# EasyEDA Pro project 温湿度及气体检测装置.eprj

# Schematic Schematic1
Create Date: 2024-08-19; Page Name: P1; Project Name: 温湿度及气体检测装置; Schematic Name: Schematic1; Update Date: 2024-08-25; Company: tllwtg; Page Size: A4; Version: V1.0
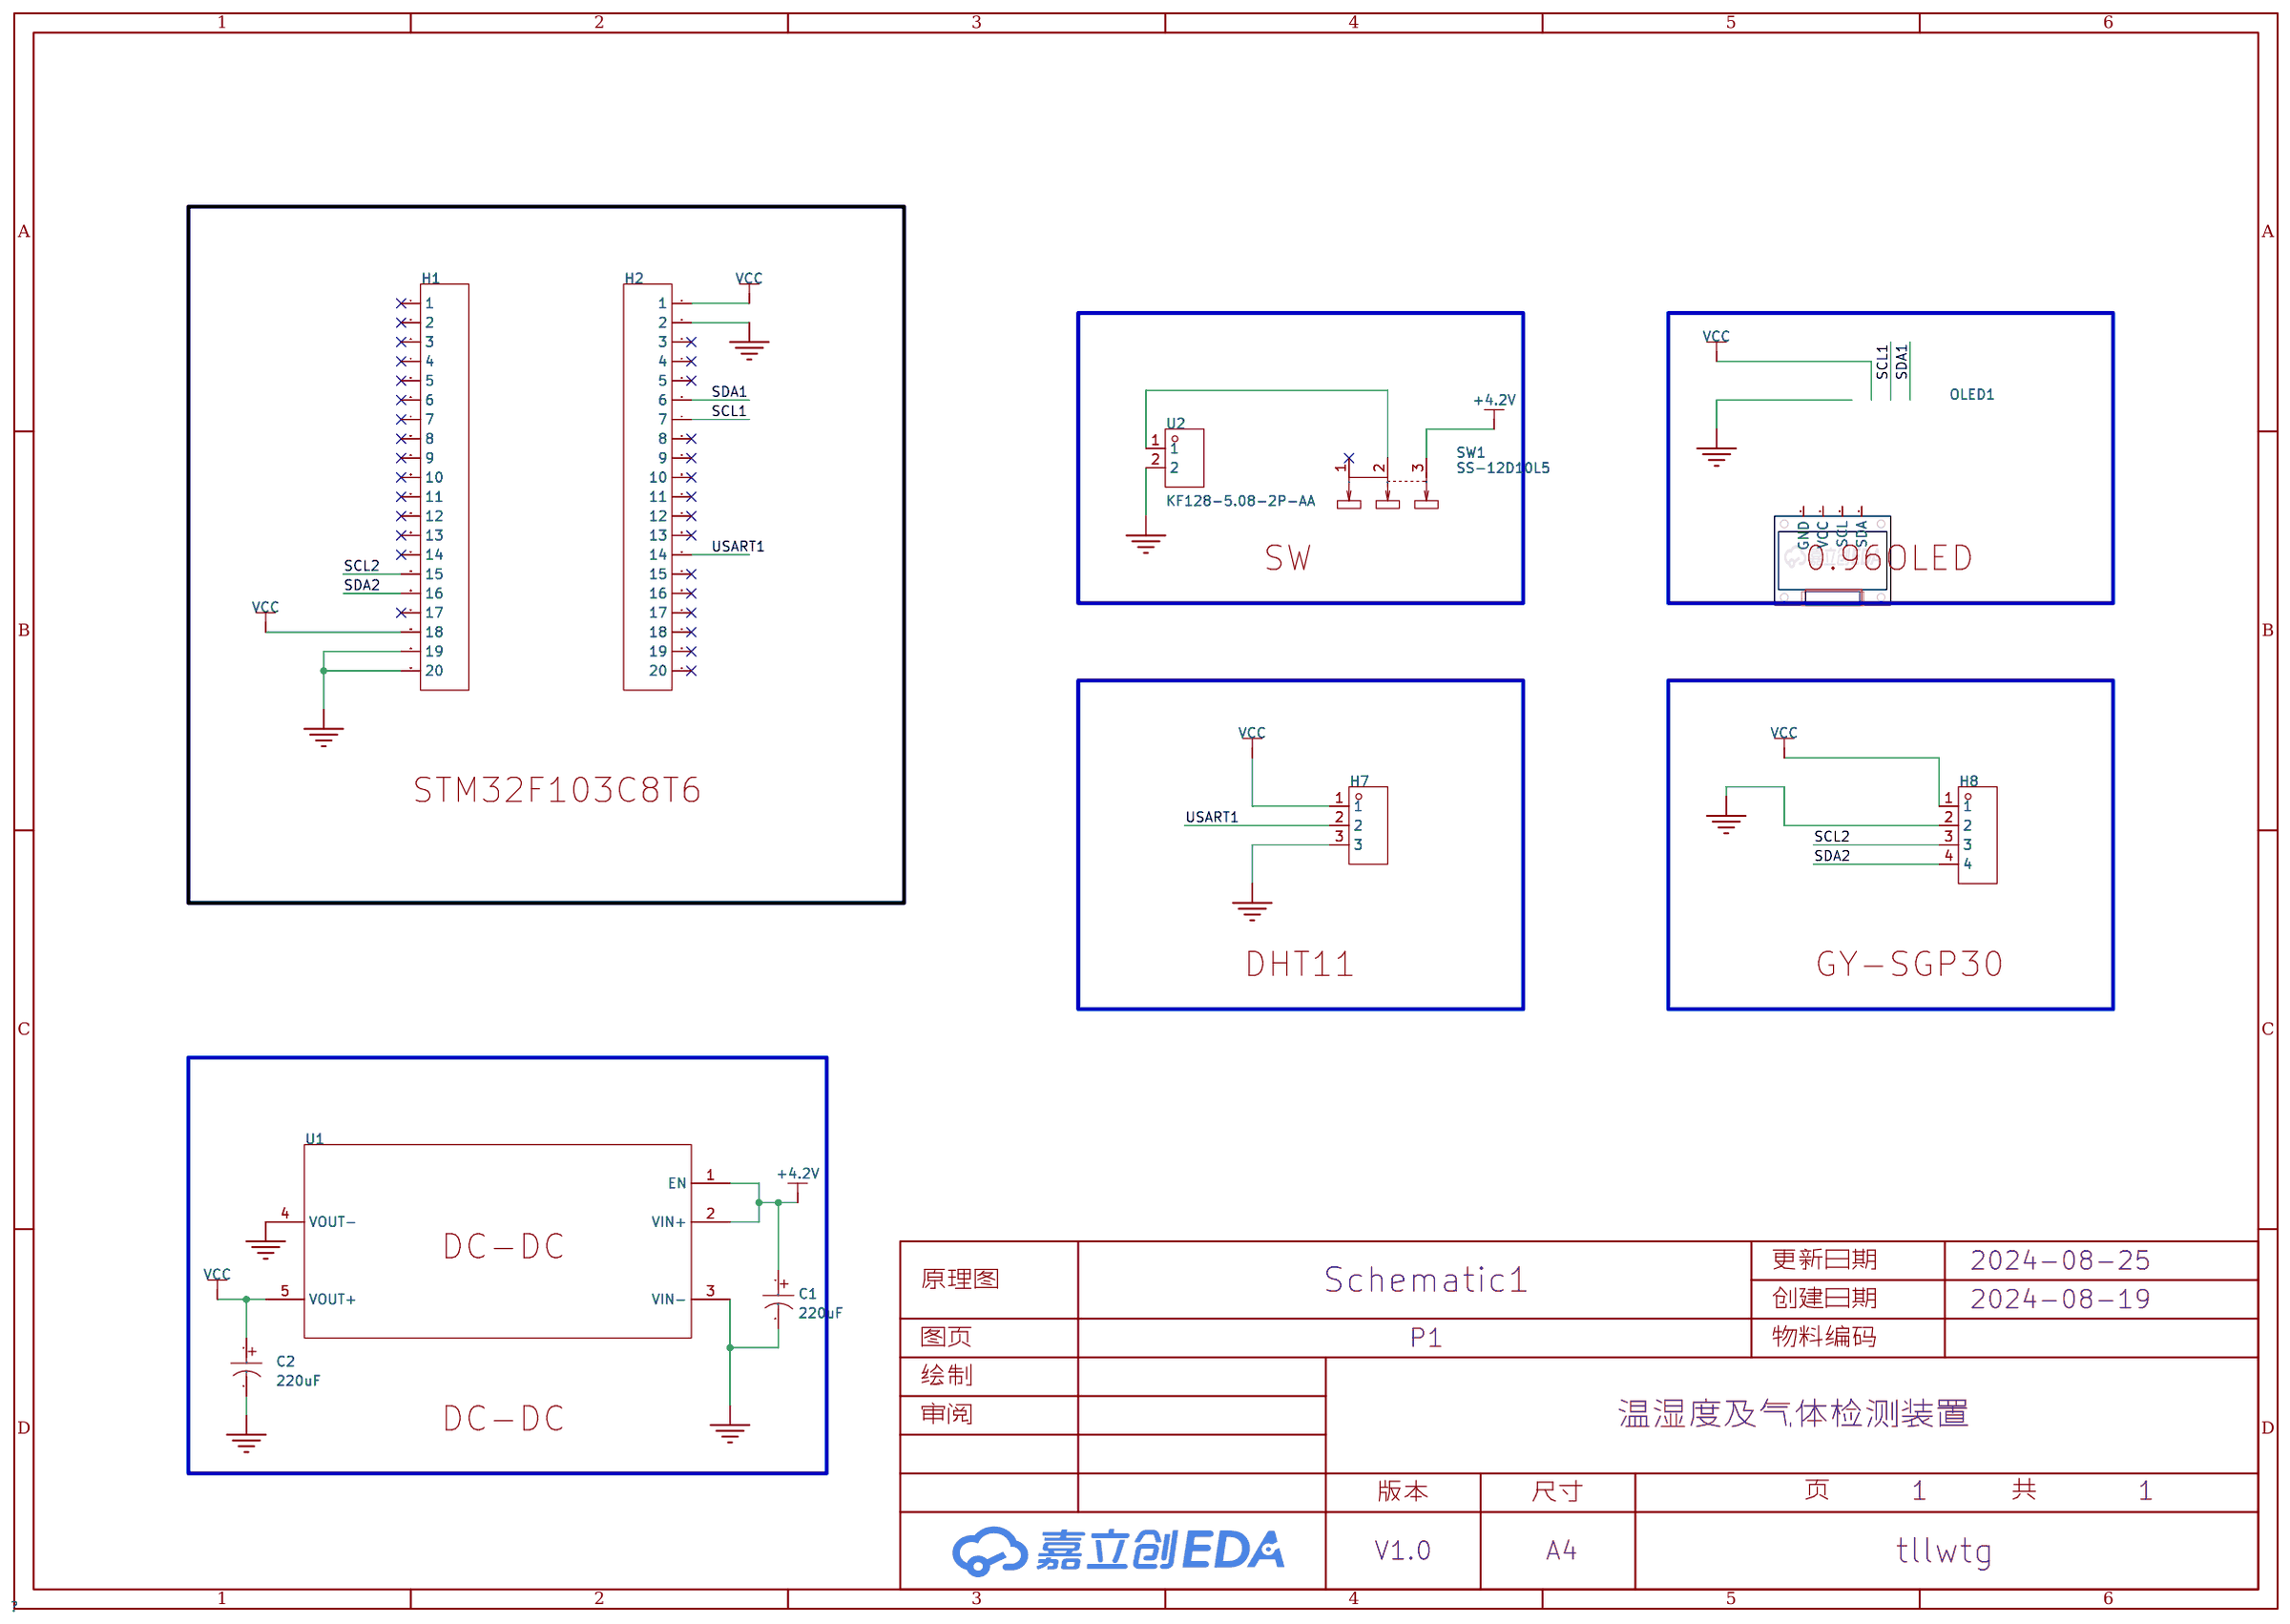
[diagram p0: schematic sheet]

## Parts
C1  220uF  [CAP-TH_BD6.3-P2.50-D1.0-FD]
C2  220uF  [CAP-TH_BD6.3-P2.50-D1.0-FD]
H1  -  [HDR-TH_20P-P2.54-V-F]
H2  -  [HDR-TH_20P-P2.54-V-F]
H7  -  [HDR-TH_3P-P2.54-V-F]
H8  -  [HDR-TH_4P-P2.54-V-F]
OLED1  -  [0.96OLED_4P]
SW1  SS-12D10L5  [SW-TH_SS-12D10L5]
U1  -  [DC-DC_upd]
U2  KF128-5.08-2P-AA  [CONN-TH_P5.08_KF128-5.08-2P]

## Library data of the parts
C1 C2 = ERS1CM221E11OT: 容值:220uF;精度:±20%;额定电压:16V;; LCSC Part Name: 220uF ±20% 16V; Supplier Part: C106643; Manufacturer: AISHI(艾华集团); Supplier Footprint: 插件,D6.3xL11mm; JLCPCB Part Class: 扩展库; Datasheet: https://atta.szlcsc.com/upload/public/pdf/source/20191015/C438940_4B8E60A742BB0AE40DDEF87A5C89089D.pdf; Supplier: LCSC; Tolerance: ±20%; Rated Voltage: 16V; Lead Spacing: 2.5mm; φD: 6.3mm; L: 11mm; Lifetime @ Temp: 5000hrs@105℃
H1 H2 = HDR-F_2.54_1x20P: Supplier Part: C50984; Supplier Footprint: 插件; Check: true
H7 = HDR-F_2.54_1x3P: Supplier Part: C541850; Supplier Footprint: 插件; Check: true
H8 = HDR-F_2.54_1x4P: Supplier Part: C2718488; Supplier Footprint: 插件; Check: true
OLED1 = 0.96OLED模块_4P: Supplier Footprint: 插件; Check: true
SW1 = SS-12D10L5: 电路结构:单刀双掷;安装方式:直插;开关颜色:黑色;额定电流(DC):3A;额定电压(DC):125V;额定电流(AC):3A;额定电压(AC):125V;机械寿命:1万次;; LCSC Part Name: 柄长5mm 直插双档 滑动开关; Supplier Part: C319012; Manufacturer: XKB Connectivity(中国星坤); Supplier Footprint: 插件; JLCPCB Part Class: 扩展库; Datasheet: https://atta.szlcsc.com/upload/public/pdf/source/20211009/D6412F37AABE6F9459A6EE7FA4DAEADB.pdf; Supplier: LCSC; Circuit: 单刀双掷; Actuator Style: 矩形柱状; Pin Style: PC引脚; Switch Length: 13mm; Switch Width: 6.8mm; Switch Height: 6.4mm; Mounting Style: 直插; Actuator Color: 黑色; Current Rating (DC): 3A; Voltage Rating (DC): 125V; Current Rating (AC): 3A; Voltage Rating (AC): 125V; Mechanical Life: 1万次; Operating Temperature: -40℃~+85℃
U1 = DC-DC: Check: true
U2 = KF128-5.08-2P-AA: 结构:1x2P;间距:5.08mm;颜色:绿色;安装方式:直插;额定电流:24A;额定电压:250V;排数:1;线规 - AWG:12~22;线规 - 平方毫米:2.5;每排PIN数:2;工作温度范围:-40℃~+105℃;; LCSC Part Name: 5.08mm 1x2P 排数:1 每排P数:2 直插; Supplier Part: C474952; Manufacturer: KEFA(科发); Supplier Footprint: 插件,P=5.08mm; JLCPCB Part Class: 扩展库; Datasheet: https://atta.szlcsc.com/upload/public/pdf/source/20230317/DADFED05827EAD48C1D5B8C3D4CF88F4.pdf; Supplier: LCSC; Structure: 1x2P; Pitch: 5.08mm; Color: 绿色; Mounting Style: 直插; Current Rating (Max): 24A; Voltage Rating (Max): 250V; Number of Pins: 2P; Number of Rows: 1; Wire Gauge - AWG: 12~22; Wire Gauge - mm2: 2.5; Number of PINs Per Row: 2; Operating Temperature Range: -40℃~+105℃; Check: true

## Nets
+4.2V: C1.1 SW1.3 U1.1(EN) U1.2(VIN+)
GND: C1.2 C2.2 H1.19 H1.20 H2.2 H7.3 H8.2 U1.3(VIN-) U1.4(VOUT-) U2.2
VCC: C2.1 H1.18 H2.1 H7.1 H8.1 U1.5(VOUT+)
SCL1: H2.7
SCL2: H1.15 H8.3
SDA1: H2.6
SDA2: H1.16 H8.4
USART1: H2.14 H7.2
$1N3125: SW1.2 U2.1

Not connected (* = marked no-connect by the designer): H1 1* 2* 3* 4* 5* 6* 7* 8* 9* 10* 11* 12* 13* 14* 17*; H2 3* 4* 5* 8* 9* 10* 11* 12* 13* 15* 16* 17* 18* 19* 20*; OLED1 1(GND) 2(VCC) 3(SCL) 4(SDA); SW1 1*

## Notes on the sheet
- SW
- 0.96OLED
- STM32F103C8T6
- DHT11
- GY-SGP30
- DC-DC

# Board PCB5
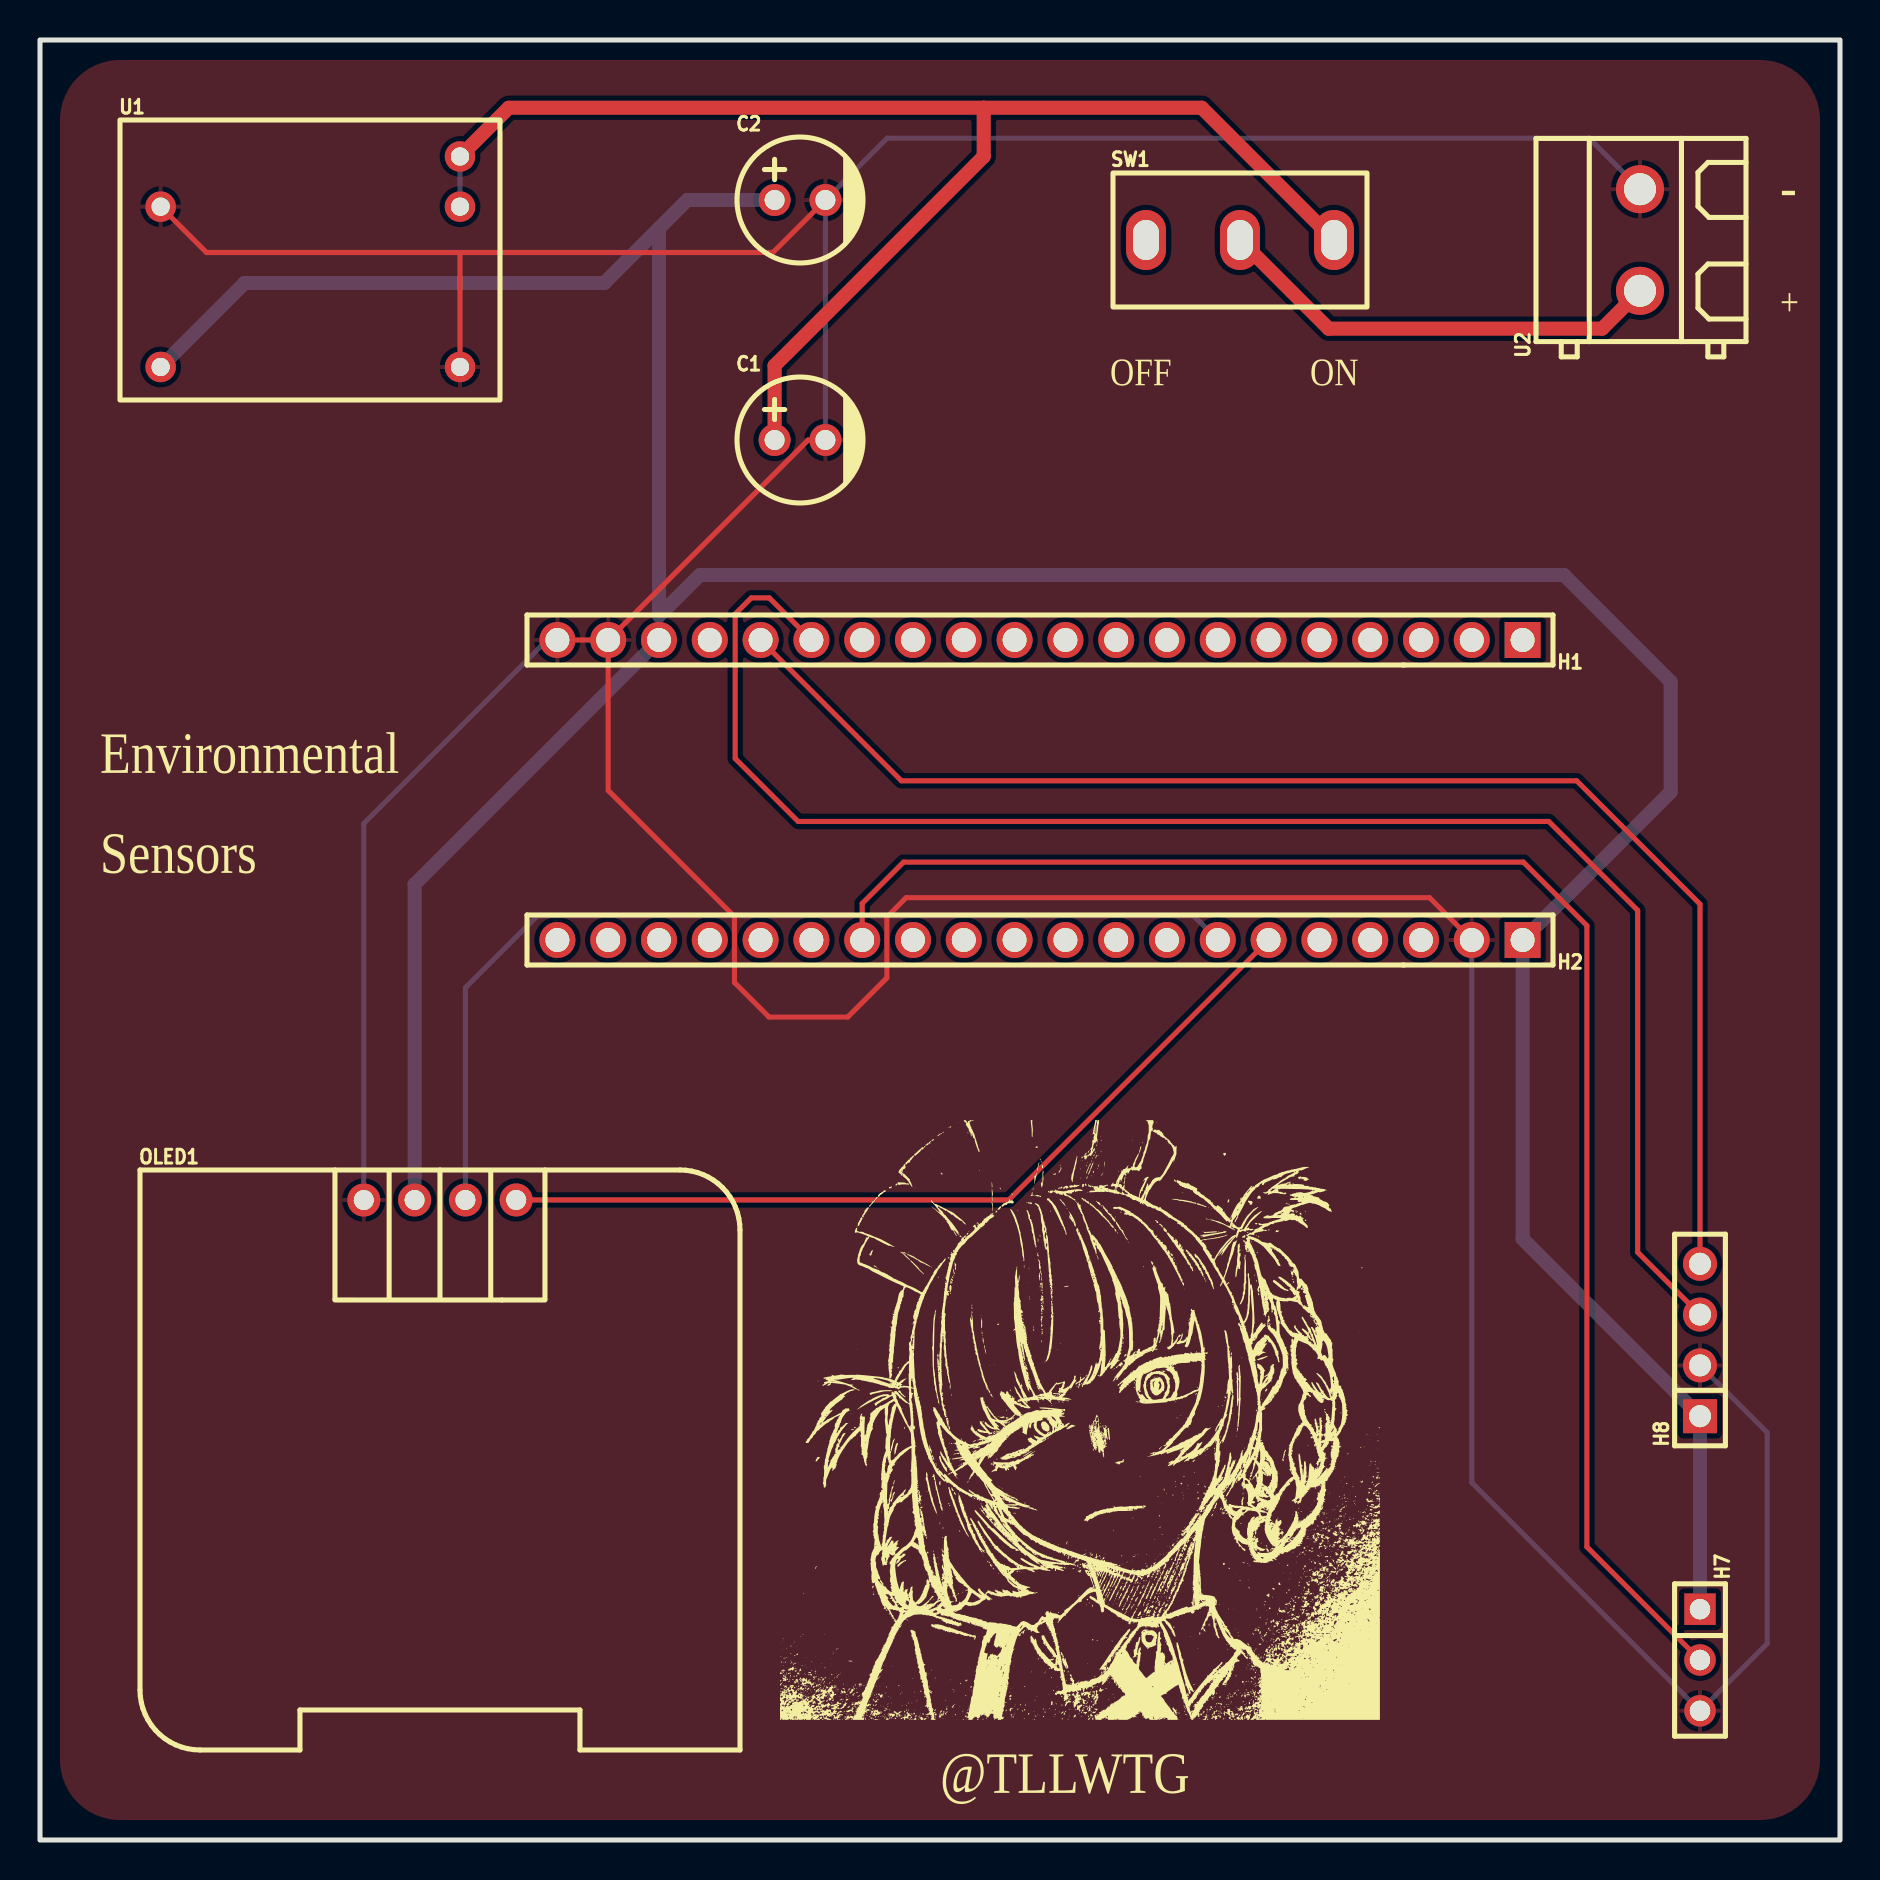
[diagram p1: board, top side]
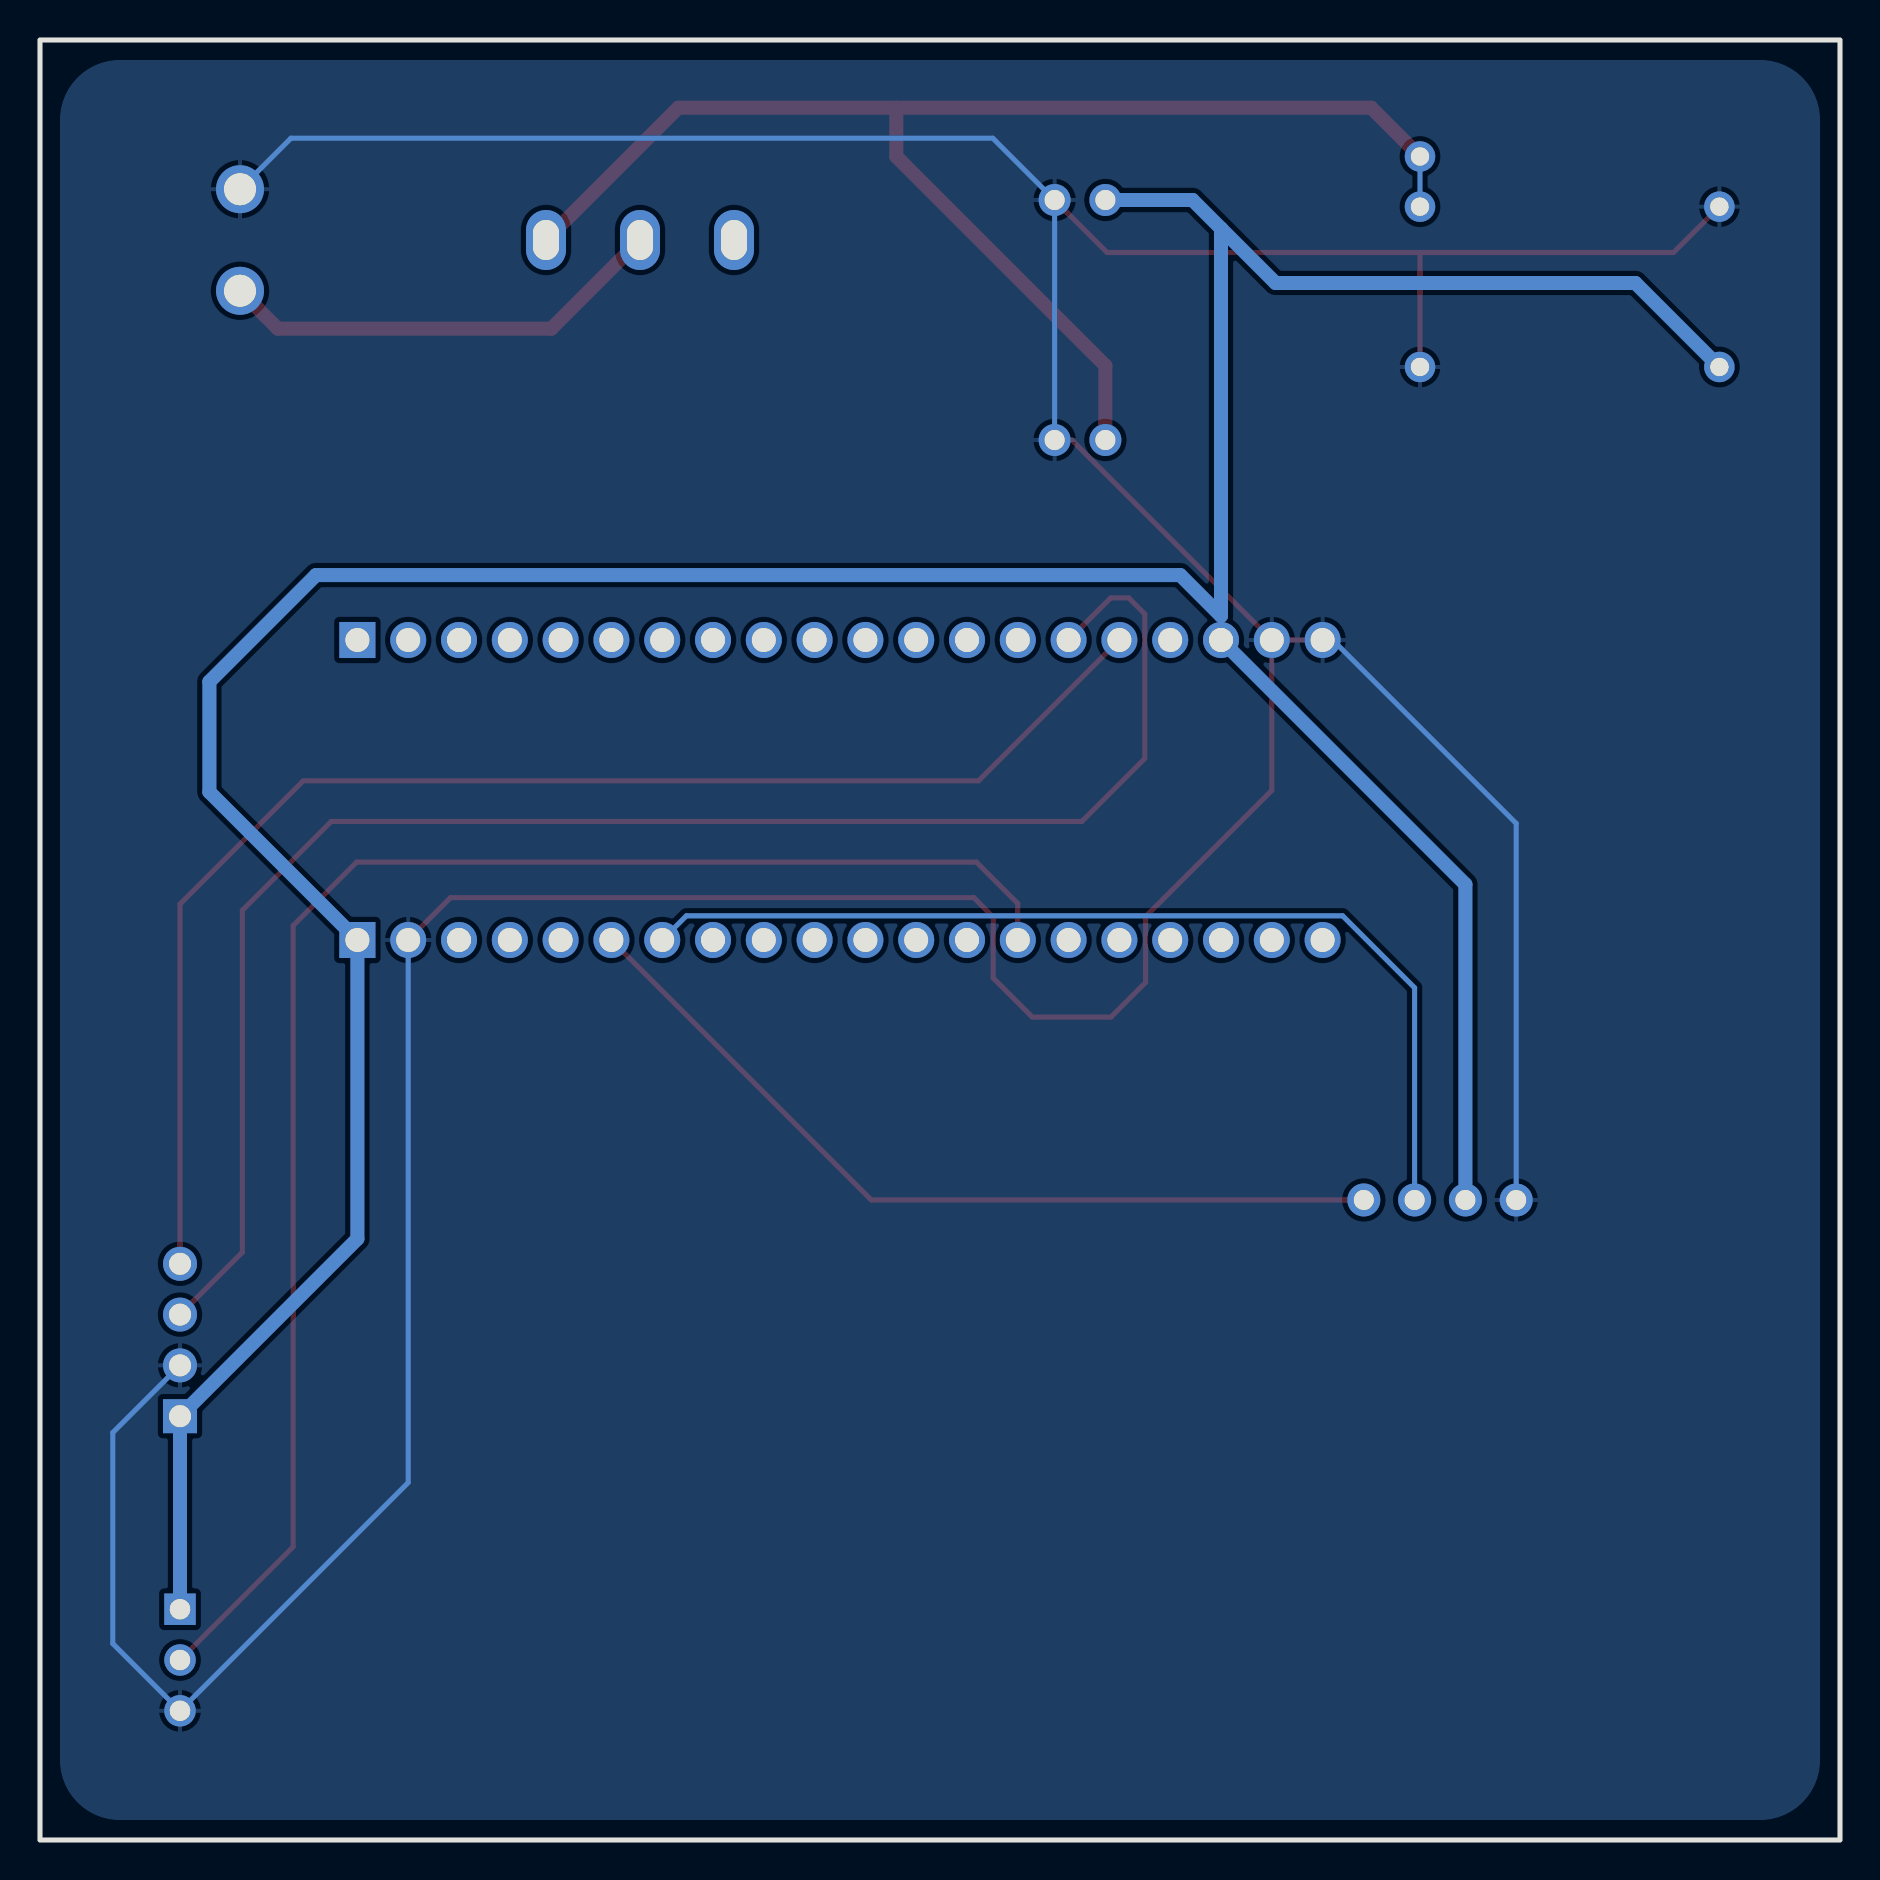
[diagram p2: board, bottom side, seen from below]

Outline 90 x 90 mm; copper layers: Top Layer, Bottom Layer. Coordinates in mm from the lower left corner of the outline.
Outline path: rectangle 0,90 90,0
Stack: Top Layer 0.035mm / Dielectric1 1.51mm FR4 er 4.5 / Bottom Layer 0.035mm

## Design rules (mm)
template: JLCPCB Capability(Two Layers Board)
spacing copperThickness1oz (default): track to track 0.102, other pairs 0.152 to 0.3
spacing copperThickness2oz: track to track 0.203, other pairs 0.152 to 0.3
track width copperThickness1oz (default): min 0.127, default 0.254, max 2.54
track width copperThickness2oz: min 0.203, default 0.254, max 2.54
differential pair differentialPair (default): width min 0.127, default 0.254, max 2.54; gap min 0.152, default 0.152
via viaSize (default): diameter min 0.5, default 0.61, max 10; hole min 0.3, default 0.305, max 6.3

## Placement (name value [footprint] x y rotation side)
C1  220uF  [CAP-TH_BD6.3-P2.50-D1.0-FD]  38 70 0 top
C2  220uF  [CAP-TH_BD6.3-P2.50-D1.0-FD]  38 82 0 top
H1  -  [HDR-TH_20P-P2.54-V-F]  50 60 180 top
H2  -  [HDR-TH_20P-P2.54-V-F]  50 45 180 top
H7  -  [HDR-TH_3P-P2.54-V-F]  83 9 270 top
H8  -  [HDR-TH_4P-P2.54-V-F]  83 25 90 top
OLED1  -  [0.96OLED_4P]  20 32 0 top
SW1  SS-12D10L5  [SW-TH_SS-12D10L5]  60 80 0 top
U1  -  [DC-DC_upd]  4 72 0 top
U2  KF128-5.08-2P-AA  [CONN-TH_P5.08_KF128-5.08-2P]  80 80 90 top

## Footprints (pads in the part's own frame, mm; a bottom-side part is the same pattern mirrored in y, then rotated)
0.96OLED_4P
  round 1.65 hole 1: 1(-3.81,-0.002) 2(-1.27,0.002) 3(1.27,0.002) 4(3.81,0.002)
CAP-TH_BD6.3-P2.50-D1.0-FD
  round 1.6 hole 1: 1(-1.27,0) 2(1.27,0)
CONN-TH_P5.08_KF128-5.08-2P
  round 2.4 hole 1.6: 1(-2.54,0) 2(2.54,0)
DC-DC_upd
  round 1.524 hole 0.914: 1(17,12.176) 2(17,9.666) 3(17,1.651) 4(2.032,1.651) 5(2.032,9.666)
HDR-TH_3P-P2.54-V-F
  round 1.575 hole 1.02: DATA(0,0) GND(2.54,0)
  rect 1.575x1.575 hole 1.02: VCC(-2.54,0)
HDR-TH_4P-P2.54-V-F
  round 1.7 hole 1.1: GND(-1.27,0) SCL(1.27,0) SDA(3.81,0)
  rect 1.7x1.7 hole 1.1: VIN(-3.81,0)
HDR-TH_20P-P2.54-V-F
  rect 1.8x1.8 hole 1.2: 1(-24.13,0)
  round 1.8 hole 1.2: 2(-21.59,0) 3(-19.05,0) 4(-16.51,0) 5(-13.97,0) 6(-11.43,0) 7(-8.89,0) 8(-6.35,0) 9(-3.81,0) 10(-1.27,0) 11(1.27,0) 12(3.81,0) 13(6.35,0) 14(8.89,0) 15(11.43,0) 16(13.97,0) 17(16.51,0) 18(19.05,0) 19(21.59,0) 20(24.13,0)
SW-TH_SS-12D10L5
  oval 2x3 hole 1.3x2: 1(-4.7,0) 2(0,0) 3(4.7,0)

## Nets
+4.2V: C1.1 SW1.3 U1.1 U1.2
GND: C1.2 C2.2 H1.19 H1.20 H2.2 H7.GND H8.GND OLED1.1 U1.3 U1.5 U2.2
VCC: C2.1 H1.18 H2.1 H7.VCC H8.VIN OLED1.2 U1.4
SCL1: H2.7 OLED1.3
SCL2: H1.15 H8.SCL
SDA1: H2.6 OLED1.4
SDA2: H1.16 H8.SDA
USART1: H2.14 H7.DATA
$1N3125: SW1.2 U2.1

Pads without a net: H1 1 2 3 4 5 6 7 8 9 10 11 12 13 14 17; H2 3 4 5 8 9 10 11 12 13 15 16 17 18 19 20; SW1 1

## Routing (per net, layer and track width the routed paths; a pad name or vN(x,y) marks a point on that pad's centre or on a via; arc(x,y) is an arc through that point)
+4.2V: length 70.9
  Top Layer w0.7: 47.19,86.61 58.09,86.61 SW1.3 ; 47.19,86.61 47.19,84.18 36.73,73.72 C1.1 ; 47.19,86.61 23.44,86.61 U1.1
  Bottom Layer w0.254: U1.2 U1.1
GND: length 271.7
  Top Layer w0.254: H1.19 38.41,70 C1.2 ; H1.19 H1.20 ; H1.19 28.41,52.48 34.72,46.17 34.72,42.88 36.45,41.15 40.39,41.15 42.34,43.1 42.34,46.15 43.31,47.12 69.47,47.12 H2.2 ; 21,79.38 8.32,79.38 U1.5 ; 21,79.38 36.65,79.38 C2.2 ; 21,79.38 U1.3
  Bottom Layer w0.254: H2.2 71.59,17.87 H7.GND 86.36,9.82 86.36,20.37 H8.GND ; U2.2 77.45,85.09 42.36,85.09 C2.2 C1.2 ; OLED1.1 16.19,50.83 25.36,60 H1.20
VCC: length 194.5
  Bottom Layer w0.254: 30.95,61.21 H1.18
  Bottom Layer w0.7: OLED1.2 18.73,47.78 H1.18 ; 30.95,80.58 32.37,82 C2.1 ; 30.95,80.58 30.95,61.21 32.99,63.25 76.2,63.25 81.53,57.92 81.53,52.4 H2.1 74.13,30.06 H8.VIN H7.VCC ; 30.95,80.58 28.22,77.85 10.23,77.85 U1.4
SCL1: length 50.2
  Bottom Layer w0.254: OLED1.3 21.27,42.61 24.87,46.21 57.68,46.21 H2.7
SCL2: length 82
  Top Layer w0.254: H8.SCL 79.88,29.39 79.88,46.48 75.44,50.93 37.91,50.93 34.76,54.08 34.76,61.3 35.56,62.1 36.47,62.1 H1.15
SDA1: length 43
  Top Layer w0.254: OLED1.4 48.43,32 H2.6
SDA2: length 70.4
  Top Layer w0.254: H1.16 43.07,52.96 76.84,52.96 83,46.79 H8.SDA
USART1: length 79.3
  Top Layer w0.254: H2.14 41.11,46.83 43.18,48.89 74.17,48.89 77.34,45.72 77.34,14.66 H7.DATA
$1N3125: length 22.6
  Top Layer w0.7: SW1.2 64.44,75.56 78.1,75.56 U2.1

## Copper pours and planes (outline as drawn; the poured copper is in the pictures)
GND on Top Layer: 1,86 1.01,86.26 1.06,86.61 1.15,86.94 1.28,87.27 1.45,87.57 1.65,87.86 1.88,88.12 2.14,88.35 2.43,88.55 2.73,88.72 3.06,88.85 3.39,88.94 3.74,88.99 4,89 86,89 86.26,88.99 86.61,88.94 86.94,88.85 87.27,88.72 87.57,88.55 87.86,88.35 88.12,88.12 88.35,87.86 88.55,87.57 88.72,87.27 88.85,86.94 88.94,86.61 88.99,86.26 89,86 89,4 88.99,3.74 88.94,3.39 88.85,3.06 88.72,2.73 88.55,2.43 88.35,2.14 88.12,1.88 87.86,1.65 87.57,1.45 87.27,1.28 86.94,1.15 86.61,1.06 86.26,1.01 86,1 4,1 3.74,1.01 3.39,1.06 3.06,1.15 2.73,1.28 2.43,1.45 2.14,1.65 1.88,1.88 1.65,2.14 1.45,2.43 1.28,2.73 1.15,3.06 1.06,3.39 1.01,3.74 1,4
GND on Bottom Layer: 1,86 1.01,86.26 1.06,86.61 1.15,86.94 1.28,87.27 1.45,87.57 1.65,87.86 1.88,88.12 2.14,88.35 2.43,88.55 2.73,88.72 3.06,88.85 3.39,88.94 3.74,88.99 4,89 86,89 86.26,88.99 86.61,88.94 86.94,88.85 87.27,88.72 87.57,88.55 87.86,88.35 88.12,88.12 88.35,87.86 88.55,87.57 88.72,87.27 88.85,86.94 88.94,86.61 88.99,86.26 89,86 89,4 88.99,3.74 88.94,3.39 88.85,3.06 88.72,2.73 88.55,2.43 88.35,2.14 88.12,1.88 87.86,1.65 87.57,1.45 87.27,1.28 86.94,1.15 86.61,1.06 86.26,1.01 86,1 4,1 3.74,1.01 3.39,1.06 3.06,1.15 2.73,1.28 2.43,1.45 2.14,1.65 1.88,1.88 1.65,2.14 1.45,2.43 1.28,2.73 1.15,3.06 1.06,3.39 1.01,3.74 1,4

## Text on the board
Top Silkscreen Layer: OFF | ON | + | Environmental | Sensors | @TLLWTG | -
